# Altium schematic sheet FPGA_Banks_66_67_68_FMC.SchDoc
size 420 x 297 mm
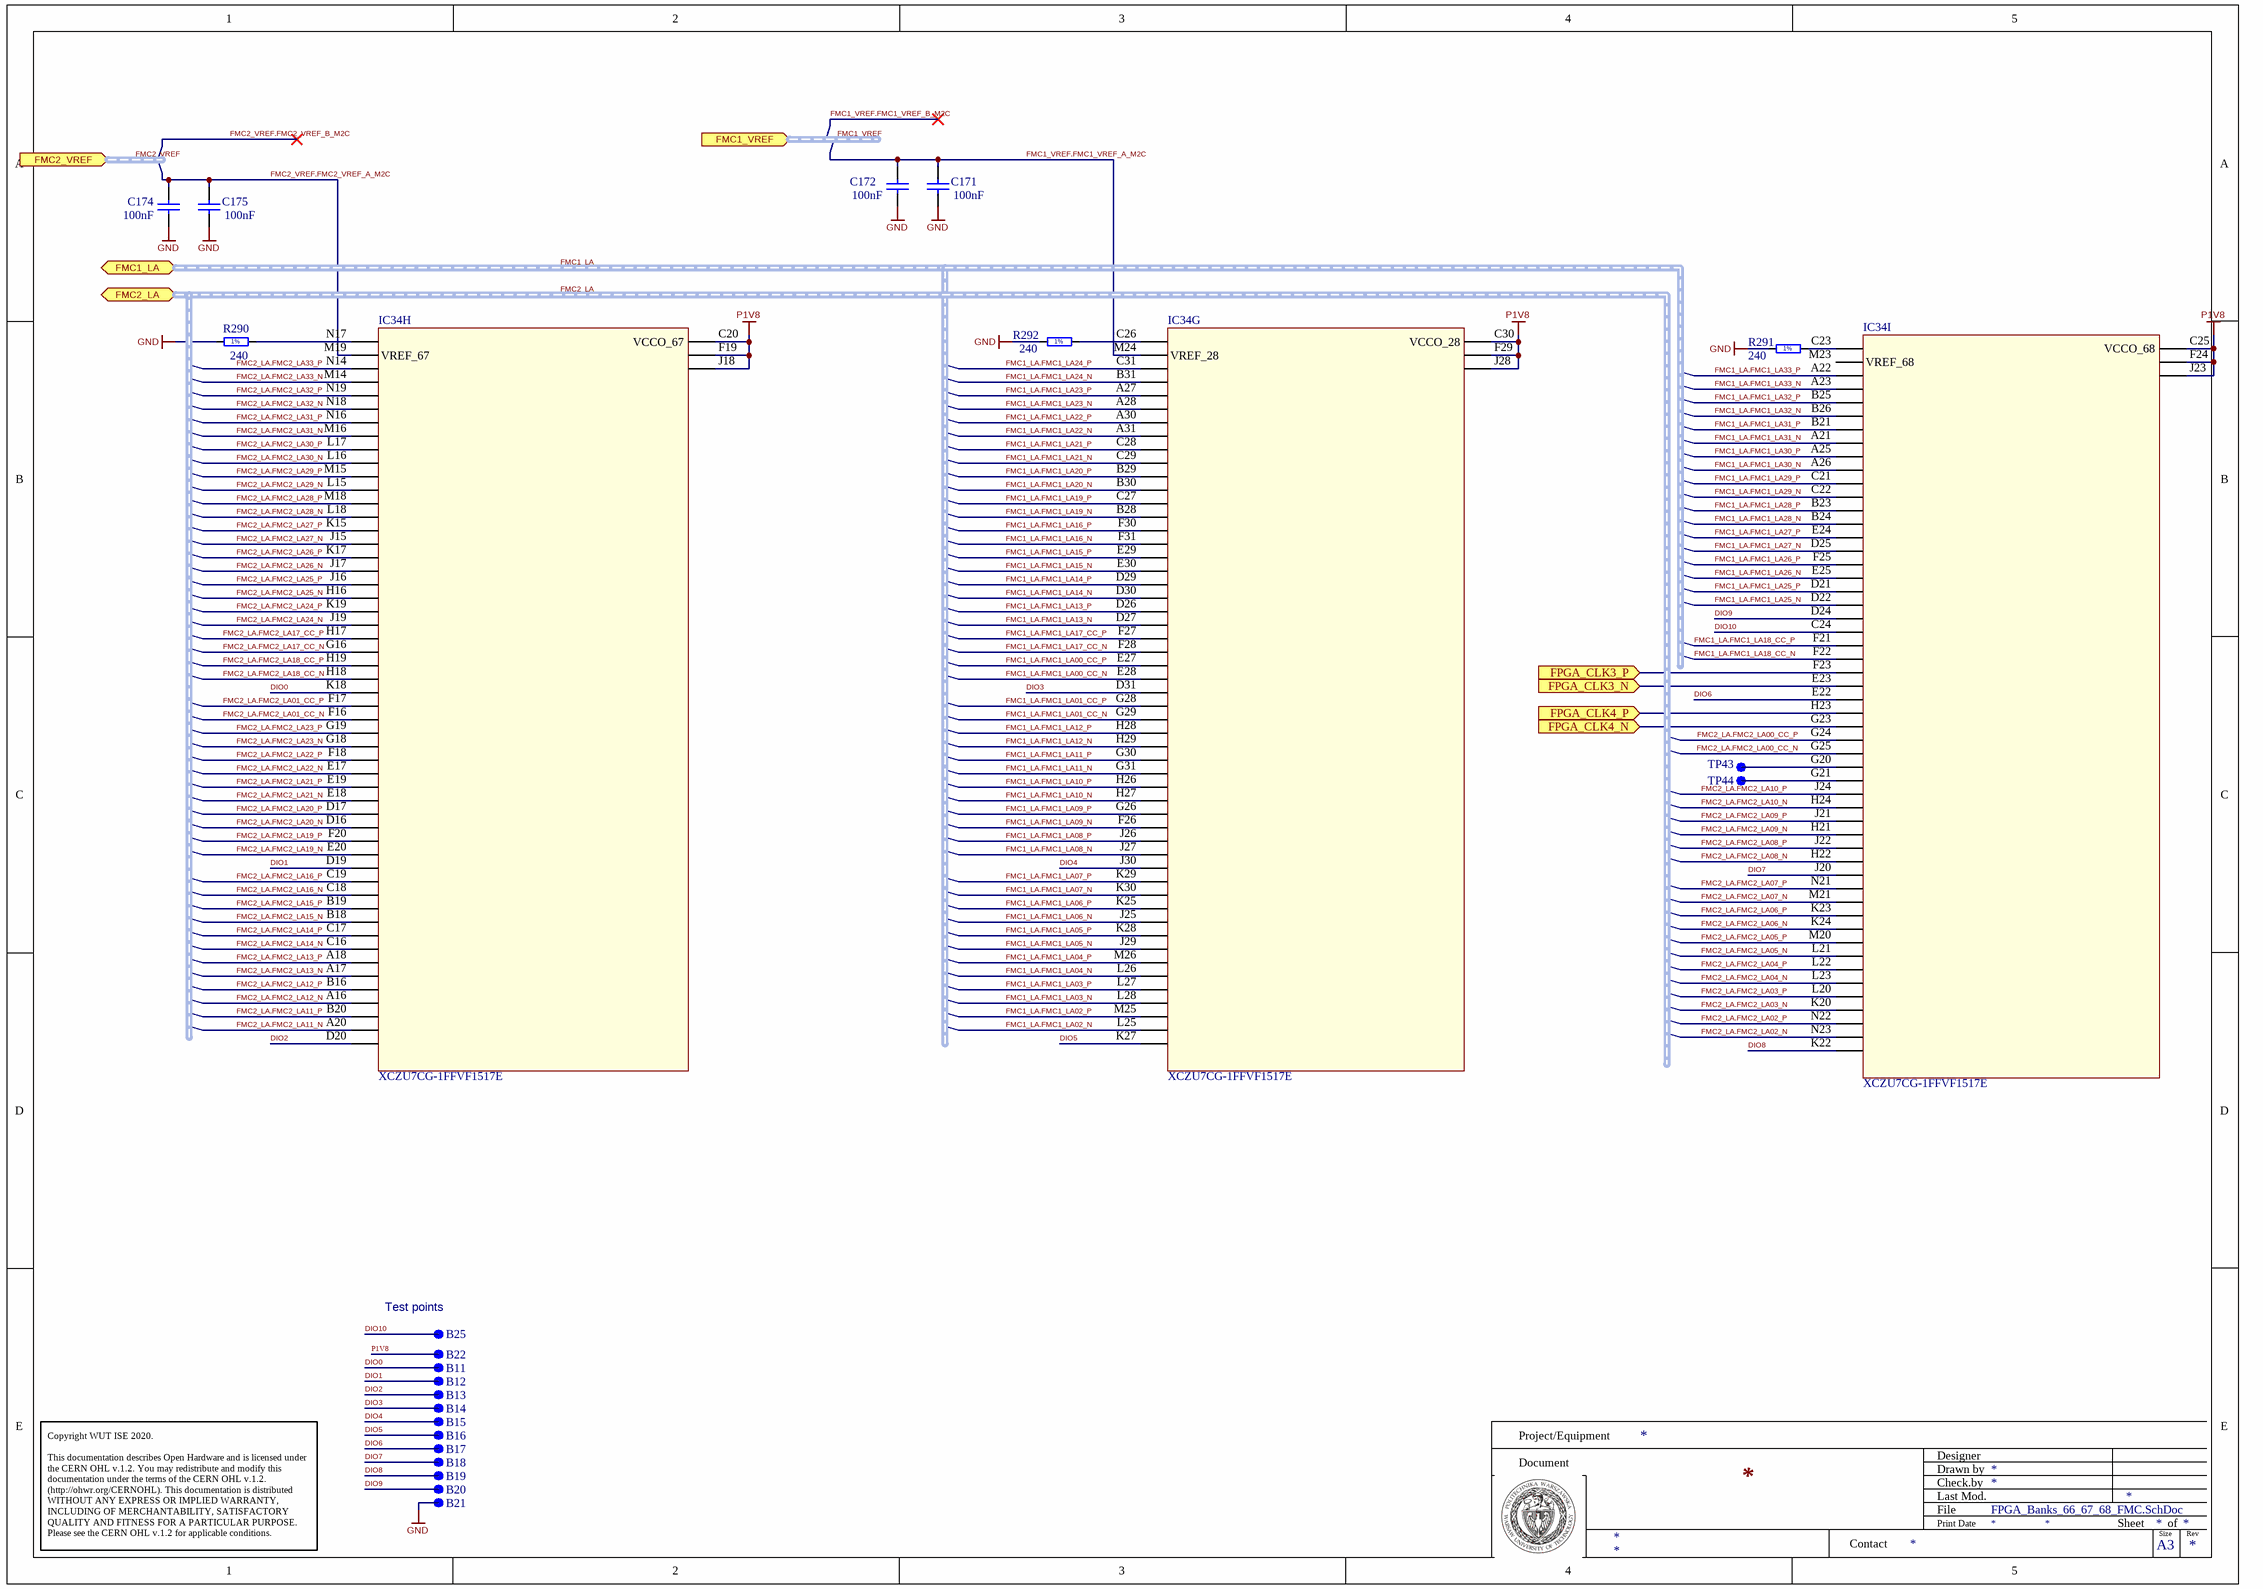
[diagram p0: FPGA_Banks_66_67_68_FMC.SchDoc]

## Parts
B11  SMD Pad  [C100]  (value not drawn)
B12  SMD Pad  [C100]  (value not drawn)
B13  SMD Pad  [C100]  (value not drawn)
B14  SMD Pad  [C100]  (value not drawn)
B15  SMD Pad  [C100]  (value not drawn)
B16  SMD Pad  [C100]  (value not drawn)
B17  SMD Pad  [C100]  (value not drawn)
B18  SMD Pad  [C100]  (value not drawn)
B19  SMD Pad  [C100]  (value not drawn)
B20  SMD Pad  [C100]  (value not drawn)
B21  SMD Pad  [C100]  (value not drawn)
B22  SMD Pad  [C100]  (value not drawn)
B25  SMD Pad  [C100]  (value not drawn)
C171  100nF  [CAPC0603X33N]
C172  100nF  [CAPC0603X33N]
C174  100nF  [CAPC0603X33N]
C175  100nF  [CAPC0603X33N]
IC34  XCZU7CG-1FFVF1517E  (parts G,H,I of 26)
R290  240  [RESC1005X40N]
R291  240  [RESC1005X40N]
R292  240  [RESC1005X40N]
TP43  SMD Pad  [C100]  (value not drawn)
TP44  SMD Pad  [C100]  (value not drawn)

## Ports
FMC1_LA (bidir, harness FMC1_LA), FMC1_VREF (in, harness FMC1_VREF), FMC2_LA (bidir, harness FMC2_LA), FMC2_VREF (in, harness FMC2_VREF), FPGA_CLK3_N (in), FPGA_CLK3_P (in), FPGA_CLK4_N (in), FPGA_CLK4_P (in)

## Nets
GND: B21.1 C171.2 C172.2 C174.2 C175.2 R290.1 R291.1 R292.1
P1V8: B22.1 IC34.C20(VCCO_67) IC34.C25(VCCO_68) IC34.C30(VCCO_28) IC34.F19(VCCO_67_1) IC34.F24(VCCO_68_1) IC34.F29(VCCO_28_1) IC34.J18(VCCO_67_2) IC34.J23(VCCO_68_2) IC34.J28(VCCO_28_2)
DIO0: B11.1 IC34.K18(IOB_X2Y233)
DIO1: B12.1 IC34.D19(IOB_X2Y246)
DIO2: B13.1 IC34.D20(IOB_X2Y259)
DIO3: B14.1 IC34.D31(IOB_X0Y285)
DIO4: B15.1 IC34.J30(IOB_X0Y298)
DIO5: B16.1 IC34.K27(IOB_X0Y311)
DIO6: B17.1 IC34.E22(IOB_X2Y285)
DIO7: B18.1 IC34.J20(IOB_X2Y298)
DIO8: B19.1 IC34.K22(IOB_X2Y311)
DIO9: B20.1 IC34.D24(IOB_X2Y279)
DIO10: B25.1 IC34.C24(IOB_X2Y280)
FMC1_LA.FMC1_LA00_CC_N: IC34.E28(IOB_X0Y284)
FMC1_LA.FMC1_LA00_CC_P: IC34.E27(IOB_X0Y283)
FMC1_LA.FMC1_LA01_CC_N: IC34.G29(IOB_X0Y287)
FMC1_LA.FMC1_LA01_CC_P: IC34.G28(IOB_X0Y286)
FMC1_LA.FMC1_LA02_N: IC34.L25(IOB_X0Y310)
FMC1_LA.FMC1_LA02_P: IC34.M25(IOB_X0Y309)
FMC1_LA.FMC1_LA03_N: IC34.L28(IOB_X0Y308)
FMC1_LA.FMC1_LA03_P: IC34.L27(IOB_X0Y307)
FMC1_LA.FMC1_LA04_N: IC34.L26(IOB_X0Y306)
FMC1_LA.FMC1_LA04_P: IC34.M26(IOB_X0Y305)
FMC1_LA.FMC1_LA05_N: IC34.J29(IOB_X0Y304)
FMC1_LA.FMC1_LA05_P: IC34.K28(IOB_X0Y303)
FMC1_LA.FMC1_LA06_N: IC34.J25(IOB_X0Y302)
FMC1_LA.FMC1_LA06_P: IC34.K25(IOB_X0Y301)
FMC1_LA.FMC1_LA07_N: IC34.K30(IOB_X0Y300)
FMC1_LA.FMC1_LA07_P: IC34.K29(IOB_X0Y299)
FMC1_LA.FMC1_LA08_N: IC34.J27(IOB_X0Y297)
FMC1_LA.FMC1_LA08_P: IC34.J26(IOB_X0Y296)
FMC1_LA.FMC1_LA09_N: IC34.F26(IOB_X0Y295)
FMC1_LA.FMC1_LA09_P: IC34.G26(IOB_X0Y294)
FMC1_LA.FMC1_LA10_N: IC34.H27(IOB_X0Y293)
FMC1_LA.FMC1_LA10_P: IC34.H26(IOB_X0Y292)
FMC1_LA.FMC1_LA11_N: IC34.G31(IOB_X0Y291)
FMC1_LA.FMC1_LA11_P: IC34.G30(IOB_X0Y290)
FMC1_LA.FMC1_LA12_N: IC34.H29(IOB_X0Y289)
FMC1_LA.FMC1_LA12_P: IC34.H28(IOB_X0Y288)
FMC1_LA.FMC1_LA13_N: IC34.D27(IOB_X0Y280)
FMC1_LA.FMC1_LA13_P: IC34.D26(IOB_X0Y279)
FMC1_LA.FMC1_LA14_N: IC34.D30(IOB_X0Y278)
FMC1_LA.FMC1_LA14_P: IC34.D29(IOB_X0Y277)
FMC1_LA.FMC1_LA15_N: IC34.E30(IOB_X0Y276)
FMC1_LA.FMC1_LA15_P: IC34.E29(IOB_X0Y275)
FMC1_LA.FMC1_LA16_N: IC34.F31(IOB_X0Y274)
FMC1_LA.FMC1_LA16_P: IC34.F30(IOB_X0Y273)
FMC1_LA.FMC1_LA17_CC_N: IC34.F28(IOB_X0Y282)
FMC1_LA.FMC1_LA17_CC_P: IC34.F27(IOB_X0Y281)
FMC1_LA.FMC1_LA18_CC_N: IC34.F22(IOB_X2Y282)
FMC1_LA.FMC1_LA18_CC_P: IC34.F21(IOB_X2Y281)
FMC1_LA.FMC1_LA19_N: IC34.B28(IOB_X0Y271)
FMC1_LA.FMC1_LA19_P: IC34.C27(IOB_X0Y270)
FMC1_LA.FMC1_LA20_N: IC34.B30(IOB_X0Y269)
FMC1_LA.FMC1_LA20_P: IC34.B29(IOB_X0Y268)
FMC1_LA.FMC1_LA21_N: IC34.C29(IOB_X0Y267)
FMC1_LA.FMC1_LA21_P: IC34.C28(IOB_X0Y266)
FMC1_LA.FMC1_LA22_N: IC34.A31(IOB_X0Y265)
FMC1_LA.FMC1_LA22_P: IC34.A30(IOB_X0Y264)
FMC1_LA.FMC1_LA23_N: IC34.A28(IOB_X0Y263)
FMC1_LA.FMC1_LA23_P: IC34.A27(IOB_X0Y262)
FMC1_LA.FMC1_LA24_N: IC34.B31(IOB_X0Y261)
FMC1_LA.FMC1_LA24_P: IC34.C31(IOB_X0Y260)
FMC1_LA.FMC1_LA25_N: IC34.D22(IOB_X2Y278)
FMC1_LA.FMC1_LA25_P: IC34.D21(IOB_X2Y277)
FMC1_LA.FMC1_LA26_N: IC34.E25(IOB_X2Y276)
FMC1_LA.FMC1_LA26_P: IC34.F25(IOB_X2Y275)
FMC1_LA.FMC1_LA27_N: IC34.D25(IOB_X2Y274)
FMC1_LA.FMC1_LA27_P: IC34.E24(IOB_X2Y273)
FMC1_LA.FMC1_LA28_N: IC34.B24(IOB_X2Y271)
FMC1_LA.FMC1_LA28_P: IC34.B23(IOB_X2Y270)
FMC1_LA.FMC1_LA29_N: IC34.C22(IOB_X2Y269)
FMC1_LA.FMC1_LA29_P: IC34.C21(IOB_X2Y268)
FMC1_LA.FMC1_LA30_N: IC34.A26(IOB_X2Y267)
FMC1_LA.FMC1_LA30_P: IC34.A25(IOB_X2Y266)
FMC1_LA.FMC1_LA31_N: IC34.A21(IOB_X2Y265)
FMC1_LA.FMC1_LA31_P: IC34.B21(IOB_X2Y264)
FMC1_LA.FMC1_LA32_N: IC34.B26(IOB_X2Y263)
FMC1_LA.FMC1_LA32_P: IC34.B25(IOB_X2Y262)
FMC1_LA.FMC1_LA33_N: IC34.A23(IOB_X2Y261)
FMC1_LA.FMC1_LA33_P: IC34.A22(IOB_X2Y260)
FMC1_VREF.FMC1_VREF_A_M2C: C171.1 C172.1 IC34.M24(VREF_28)
FMC2_LA.FMC2_LA00_CC_N: IC34.G25(IOB_X2Y289)
FMC2_LA.FMC2_LA00_CC_P: IC34.G24(IOB_X2Y288)
FMC2_LA.FMC2_LA01_CC_N: IC34.F16(IOB_X2Y235)
FMC2_LA.FMC2_LA01_CC_P: IC34.F17(IOB_X2Y234)
FMC2_LA.FMC2_LA02_N: IC34.N23(IOB_X2Y310)
FMC2_LA.FMC2_LA02_P: IC34.N22(IOB_X2Y309)
FMC2_LA.FMC2_LA03_N: IC34.K20(IOB_X2Y308)
FMC2_LA.FMC2_LA03_P: IC34.L20(IOB_X2Y307)
FMC2_LA.FMC2_LA04_N: IC34.L23(IOB_X2Y306)
FMC2_LA.FMC2_LA04_P: IC34.L22(IOB_X2Y305)
FMC2_LA.FMC2_LA05_N: IC34.L21(IOB_X2Y304)
FMC2_LA.FMC2_LA05_P: IC34.M20(IOB_X2Y303)
FMC2_LA.FMC2_LA06_N: IC34.K24(IOB_X2Y302)
FMC2_LA.FMC2_LA06_P: IC34.K23(IOB_X2Y301)
FMC2_LA.FMC2_LA07_N: IC34.M21(IOB_X2Y300)
FMC2_LA.FMC2_LA07_P: IC34.N21(IOB_X2Y299)
FMC2_LA.FMC2_LA08_N: IC34.H22(IOB_X2Y297)
FMC2_LA.FMC2_LA08_P: IC34.J22(IOB_X2Y296)
FMC2_LA.FMC2_LA09_N: IC34.H21(IOB_X2Y295)
FMC2_LA.FMC2_LA09_P: IC34.J21(IOB_X2Y294)
FMC2_LA.FMC2_LA10_N: IC34.H24(IOB_X2Y293)
FMC2_LA.FMC2_LA10_P: IC34.J24(IOB_X2Y292)
FMC2_LA.FMC2_LA11_N: IC34.A20(IOB_X2Y258)
FMC2_LA.FMC2_LA11_P: IC34.B20(IOB_X2Y257)
FMC2_LA.FMC2_LA12_N: IC34.A16(IOB_X2Y256)
FMC2_LA.FMC2_LA12_P: IC34.B16(IOB_X2Y255)
FMC2_LA.FMC2_LA13_N: IC34.A17(IOB_X2Y254)
FMC2_LA.FMC2_LA13_P: IC34.A18(IOB_X2Y253)
FMC2_LA.FMC2_LA14_N: IC34.C16(IOB_X2Y252)
FMC2_LA.FMC2_LA14_P: IC34.C17(IOB_X2Y251)
FMC2_LA.FMC2_LA15_N: IC34.B18(IOB_X2Y250)
FMC2_LA.FMC2_LA15_P: IC34.B19(IOB_X2Y249)
FMC2_LA.FMC2_LA16_N: IC34.C18(IOB_X2Y248)
FMC2_LA.FMC2_LA16_P: IC34.C19(IOB_X2Y247)
FMC2_LA.FMC2_LA17_CC_N: IC34.G16(IOB_X2Y230)
FMC2_LA.FMC2_LA17_CC_P: IC34.H17(IOB_X2Y229)
FMC2_LA.FMC2_LA18_CC_N: IC34.H18(IOB_X2Y232)
FMC2_LA.FMC2_LA18_CC_P: IC34.H19(IOB_X2Y231)
FMC2_LA.FMC2_LA19_N: IC34.E20(IOB_X2Y245)
FMC2_LA.FMC2_LA19_P: IC34.F20(IOB_X2Y244)
FMC2_LA.FMC2_LA20_N: IC34.D16(IOB_X2Y243)
FMC2_LA.FMC2_LA20_P: IC34.D17(IOB_X2Y242)
FMC2_LA.FMC2_LA21_N: IC34.E18(IOB_X2Y241)
FMC2_LA.FMC2_LA21_P: IC34.E19(IOB_X2Y240)
FMC2_LA.FMC2_LA22_N: IC34.E17(IOB_X2Y239)
FMC2_LA.FMC2_LA22_P: IC34.F18(IOB_X2Y238)
FMC2_LA.FMC2_LA23_N: IC34.G18(IOB_X2Y237)
FMC2_LA.FMC2_LA23_P: IC34.G19(IOB_X2Y236)
FMC2_LA.FMC2_LA24_N: IC34.J19(IOB_X2Y228)
FMC2_LA.FMC2_LA24_P: IC34.K19(IOB_X2Y227)
FMC2_LA.FMC2_LA25_N: IC34.H16(IOB_X2Y226)
FMC2_LA.FMC2_LA25_P: IC34.J16(IOB_X2Y225)
FMC2_LA.FMC2_LA26_N: IC34.J17(IOB_X2Y224)
FMC2_LA.FMC2_LA26_P: IC34.K17(IOB_X2Y223)
FMC2_LA.FMC2_LA27_N: IC34.J15(IOB_X2Y222)
FMC2_LA.FMC2_LA27_P: IC34.K15(IOB_X2Y221)
FMC2_LA.FMC2_LA28_N: IC34.L18(IOB_X2Y219)
FMC2_LA.FMC2_LA28_P: IC34.M18(IOB_X2Y218)
FMC2_LA.FMC2_LA29_N: IC34.L15(IOB_X2Y217)
FMC2_LA.FMC2_LA29_P: IC34.M15(IOB_X2Y216)
FMC2_LA.FMC2_LA30_N: IC34.L16(IOB_X2Y215)
FMC2_LA.FMC2_LA30_P: IC34.L17(IOB_X2Y214)
FMC2_LA.FMC2_LA31_N: IC34.M16(IOB_X2Y213)
FMC2_LA.FMC2_LA31_P: IC34.N16(IOB_X2Y212)
FMC2_LA.FMC2_LA32_N: IC34.N18(IOB_X2Y211)
FMC2_LA.FMC2_LA32_P: IC34.N19(IOB_X2Y210)
FMC2_LA.FMC2_LA33_N: IC34.M14(IOB_X2Y209)
FMC2_LA.FMC2_LA33_P: IC34.N14(IOB_X2Y208)
FMC2_VREF.FMC2_VREF_A_M2C: C174.1 C175.1 IC34.M19(VREF_67)
FPGA_CLK3_N: IC34.E23(IOB_X2Y284) ; port FPGA_CLK3_N
FPGA_CLK3_P: IC34.F23(IOB_X2Y283) ; port FPGA_CLK3_P
FPGA_CLK4_N: IC34.G23(IOB_X2Y287) ; port FPGA_CLK4_N
FPGA_CLK4_P: IC34.H23(IOB_X2Y286) ; port FPGA_CLK4_P
NetIC34_C23: IC34.C23(IOB_X2Y272) R291.2
NetIC34_C26: IC34.C26(IOB_X0Y272) R292.2
NetIC34_G20: IC34.G20(IOB_X2Y290) TP43.1
NetIC34_G21: IC34.G21(IOB_X2Y291) TP44.1
NetIC34_N17: IC34.N17(IOB_X2Y220) R290.2

Not connected (* = marked no-connect by the designer): IC34 M23(VREF_68)

## Buses and harness runs
harness FMC1_LA = port FMC1_LA
harness FMC1_VREF = port FMC1_VREF
harness FMC2_LA = port FMC2_LA
harness FMC2_VREF = port FMC2_VREF

## Notes on the sheet
- (near B25) Test points
- Project/Equipment
- Document
- Designer
- Drawn by
- Check.by
- Copyright WUT ISE 2020.
  This documentation describes Open Hardware and is licensed under the CERN OHL v.1.2. You may redistribute and modify this documentation under the terms of the CERN OHL v.1.2. (http://ohwr.org/CERNOHL). This documentation is distributed WITHOUT ANY EXPRESS OR IMPLIED WARRANTY, INCLUDING OF MERCHANTABILITY, SATISFACTORY QUALITY AND FITNESS FOR A PARTICULAR PURPOSE. Please see the CERN OHL v.1.2 for applicable conditions.
- Contact
- File
- Last Mod.
- Print Date
- Sheet
- Size
- A3
- of
- Rev
- (in symbol R0402_240R_1%_0.0625W_100PPM) 1%

## Library data of the parts
B11-B22 B25 TP43 TP44 = SMD_PAD_D1MM: Through Hole Pad; Part Description: 1mm Diameter SMD Pad; Mounted: No; PackageDescription: 1mm Diameter SMD Pad; Part Number: SMD_PAD_D1MM; Component Kind: Standard (No BOM); Component Type: Standard (No BOM); Pin Count: 1; Family: SMD Pad; Socket: No; SMD: No; Sense: No; Status: None; ComponentHeight: 0mm; HelpURL: Undefined; Author: CERN DEM JLC; CreateDate: 10/10/2017; LatestRevisionDate: 10/10/2017
C171 C172 C175 = CC0201_100NF_6.3V_10%_X5R: Non-polarised capacitor; Manufacturer: GENERIC; Manufacturer1 Part Number: 02016D104KAT2A; Part Description: SMD Multilayer Chip Ceramic Capacitor; TC: X5R; Tolerance: ±10%; Voltage: 6.3V; Author: CERN DEM JLC; Case: 0201; Component Kind: Standard; Component Type: Standard; CreateDate: 03/12/2007; HelpURL: \\cern.ch\dfs\Applications\Altium\Datasheets\CC0201_X5R_AVX.pdf; LatestRevisionDate: 03/12/2007; Manufacturer Part Number: CC0201_100NF_6.3V_10%_X5R; Manufacturer1 ComponentHeight: 0.33mm; Manufacturer1 Example: AVX; Mounted: Yes; Part Number: CC0201_100NF_6.3V_10%_X5R; Pin Count: 2; SMD: Yes; Socket: No; Status: Not Recommended; Value: 100nF; Sense: No
C174 = CC0201_100NF_6.3V_10%_X5R: Non-polarised capacitor; Manufacturer: GENERIC; Part Description: SMD Multilayer Chip Ceramic Capacitor; Manufacturer1 Part Number: 02016D104KAT2A; Tolerance: ±10%; Voltage: 6.3V; TC: X5R; Manufacturer Part Number: CC0201_100NF_6.3V_10%_X5R; Part Number: CC0201_100NF_6.3V_10%_X5R; Value: 100nF; Component Kind: Standard; Component Type: Standard; Pin Count: 2; Status: Not Recommended; Case: 0201; Mounted: Yes; Socket: No; SMD: Yes; Sense: No; Manufacturer1 Example: AVX; Manufacturer1 ComponentHeight: 0.33mm; HelpURL: \\cern.ch\dfs\Applications\Altium\Datasheets\CC0201_X5R_AVX.pdf; Author: CERN DEM JLC; CreateDate: 03/12/2007; LatestRevisionDate: 03/12/2007
R290-R292 = R0402_240R_1%_0.0625W_100PPM: Resistor - 1%; Manufacturer: GENERIC; Part Description: General Purpose Thick Film Chip Resistor; Manufacturer1 Part Number: 232270672401L; TC: ±100ppm/°C; PressFit: No; Manufacturer Part Number: R0402_240R_1%_0.0625W_100PPM; Part Number: R0402_240R_1%_0.0625W_100PPM; Tolerance: ±1%; Value: 240; Component Kind: Standard; Component Type: Standard; Pin Count: 2; Status: Not Recommended; Power: 0.0625W; Case: 0402; Mounted: Yes; Sense: No; Socket: No; SMD: Yes; Manufacturer1 Example: YAGEO PHYCOMP; Manufacturer1 ComponentHeight: 0.4mm; HelpURL: \\cern.ch\dfs\Applications\Altium\Datasheets\R0402_Phycomp_RC0402.pdf; Author: CERN DEM JLC; CreateDate: 03/12/2007; LatestRevisionDate: 17/10/2012